# EasyEDA Pro project kuafu01_030内部老化方案_4.eprj, board PCB4 (continued)
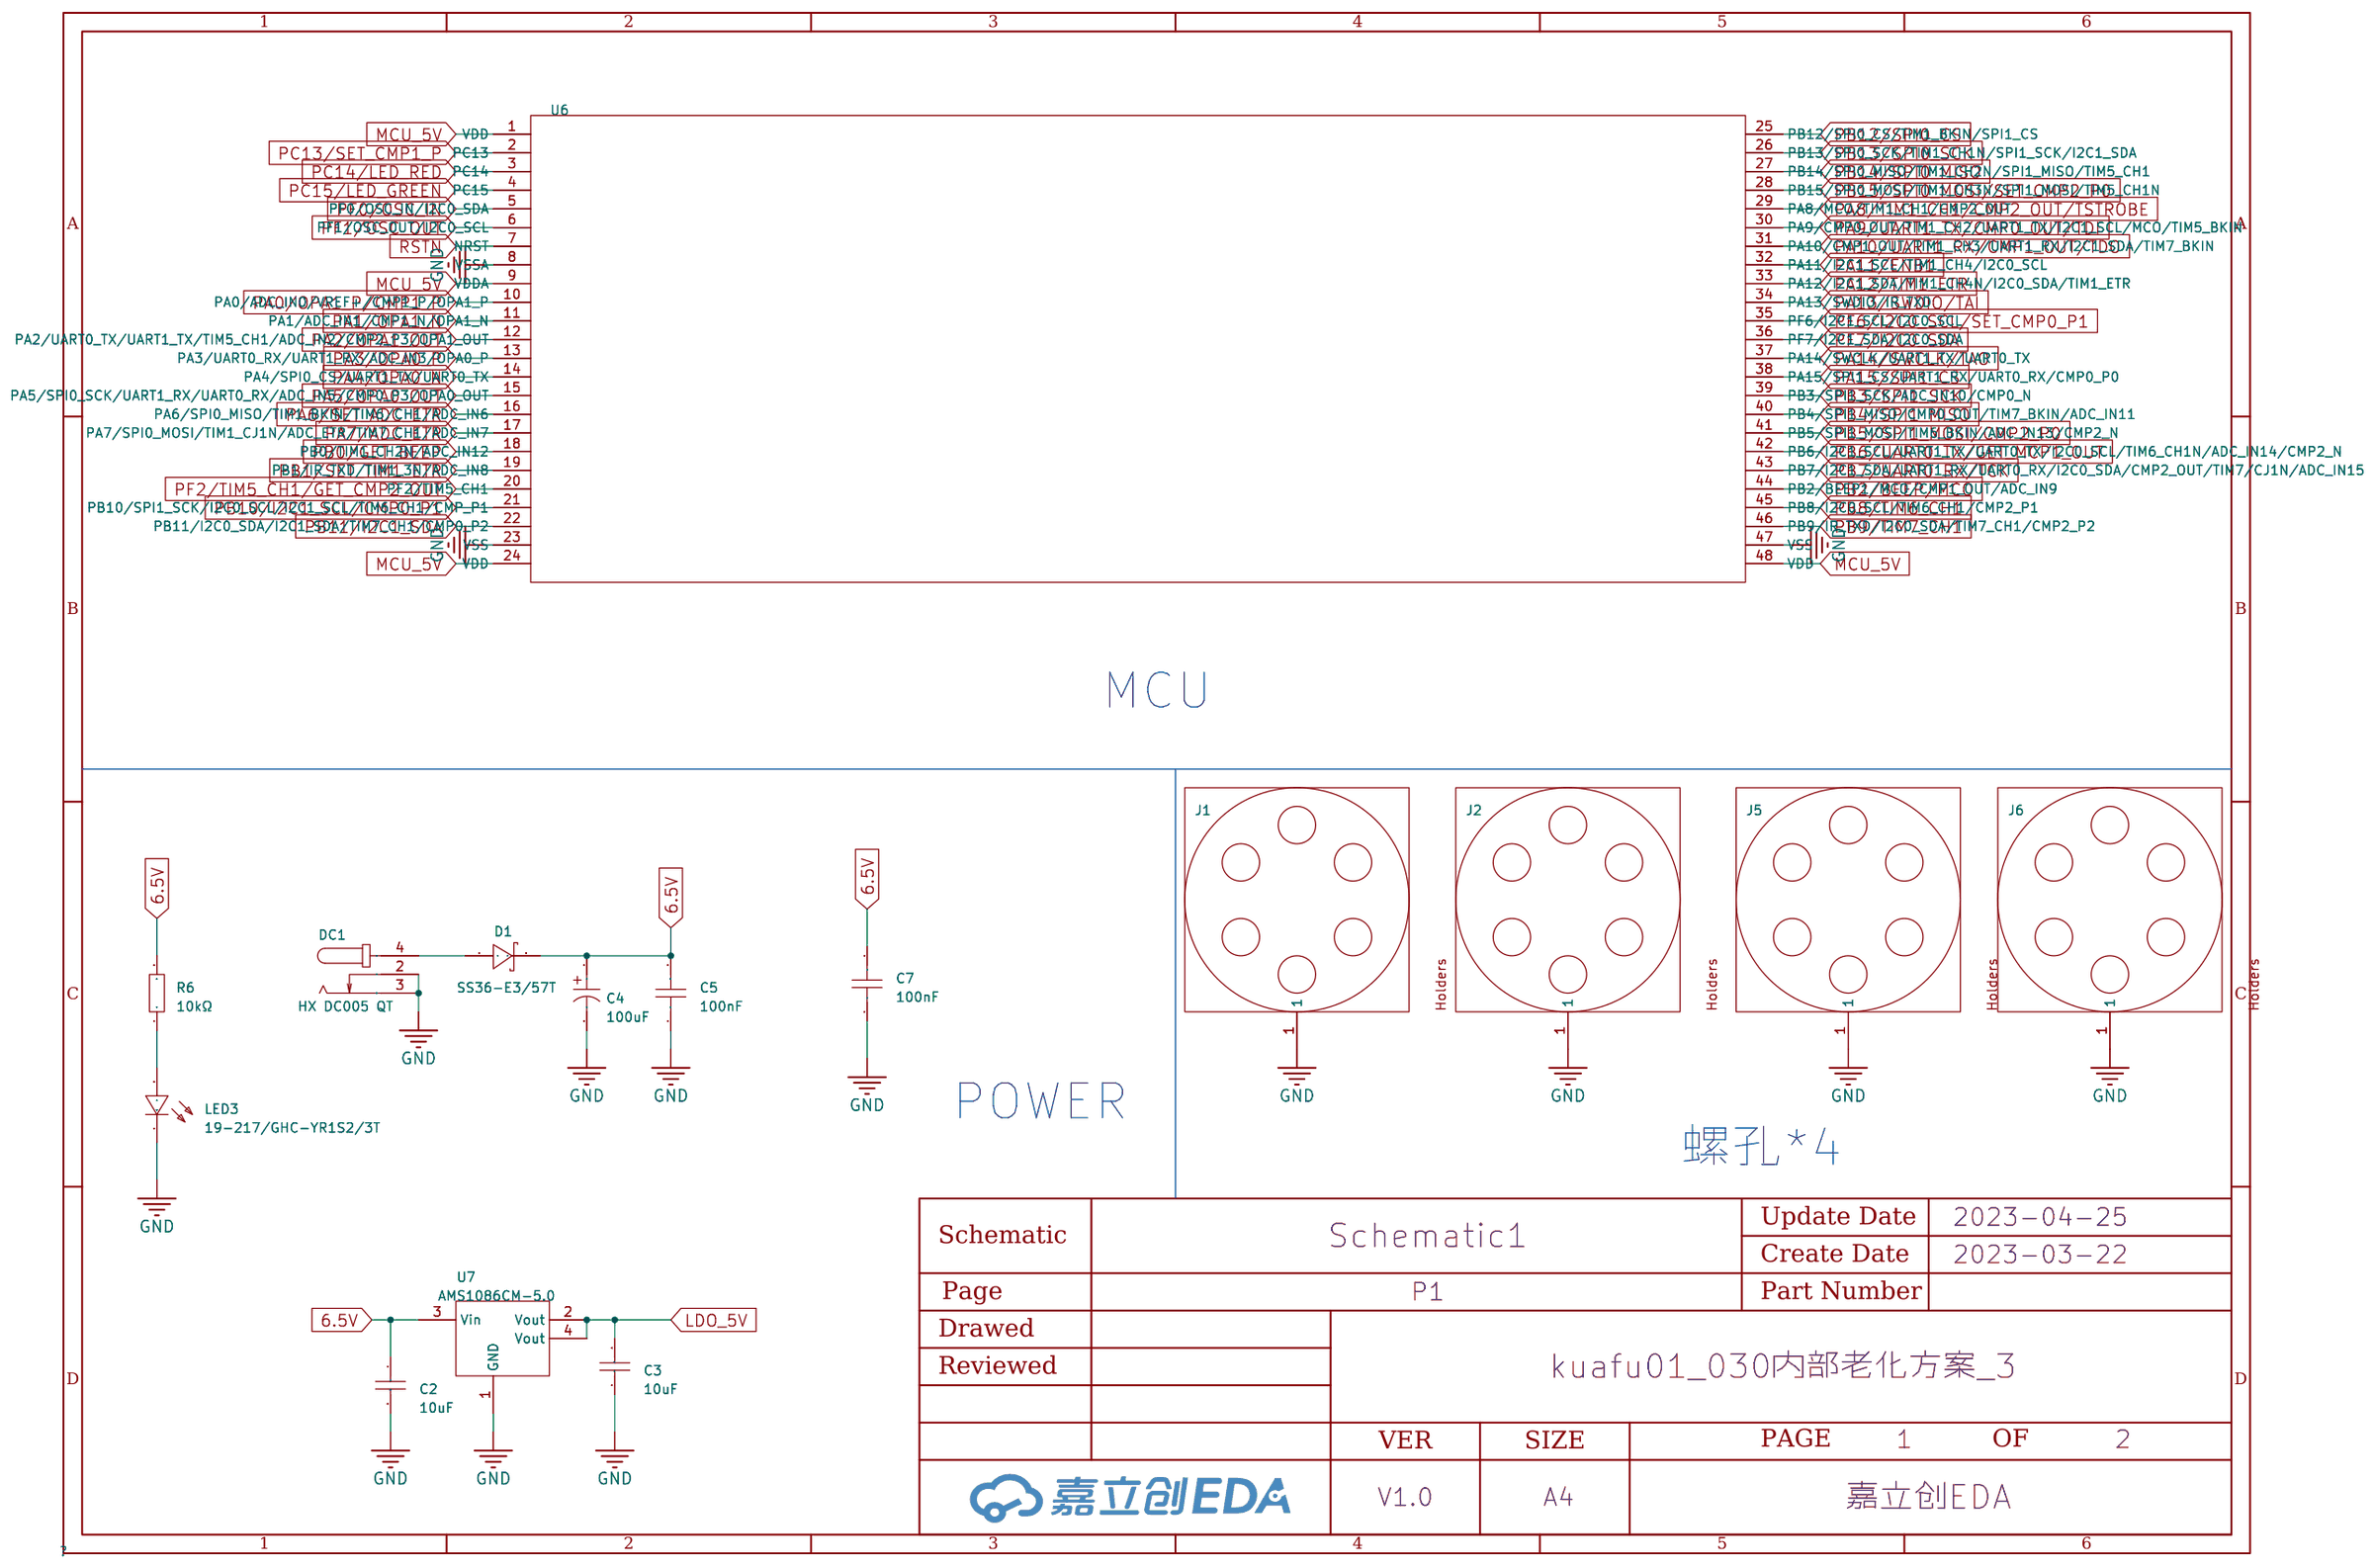
[diagram p0: P1]
## Routing (per net, layer and track width the routed paths; a pad name or vN(x,y) marks a point on that pad's centre or on a via; arc(x,y) is an arc through that point) (continued)
PB14/SPI0_MISO: length 791.7
  Top Layer w0.28: v1(242.26,245.05) 235.5,245.05 234.28,243.83 234.28,242.07 U6#26.40 ; v1(191.71,207.46) 184.95,207.46 183.73,206.24 183.73,204.48 U6#32.40 ; U6#20.27 35.04,85.74 36.06,85.74 36.4,85.4 40.07,85.4 v1(40.07,85.4) ; v1(141.17,169.87) 134.41,169.87 133.19,168.65 133.19,166.89 U6#8.40 ; U6#12.27 136.13,236.1 137.16,236.1 137.49,235.77 141.16,235.77 v1(141.17,235.76) ; U6#21.40 183.73,91.7 183.73,93.47 184.95,94.69 v1(191.71,94.69) ; U6#15.40 234.28,54.11 234.28,55.87 235.5,57.09 v1(242.26,57.09) ; v1(141.17,47.8) 141.16,47.81 137.49,47.81 137.16,48.14 136.13,48.14 U6#13.27 ; v1(141.17,198.17) 141.16,198.17 137.49,198.17 137.16,198.51 136.13,198.51 U6#30.27 ; v1(40.07,132.28) 33.31,132.28 32.09,131.06 32.09,129.29 U6#3.40 ; v1(191.71,85.4) 191.71,85.4 188.04,85.4 187.7,85.74 186.67,85.74 U6#21.27 ; U6#18.27 186.67,48.14 187.7,48.14 188.04,47.81 191.71,47.81 v1(191.71,47.8) ; U6#29.40 82.64,204.48 82.64,206.24 83.86,207.46 v1(90.62,207.46) ; v1(90.62,160.58) 90.62,160.58 86.95,160.58 86.61,160.92 85.58,160.92 U6#11.27 ; v1(242.26,19.5) 235.5,19.5 234.28,18.28 234.28,16.52 U6#24.40 ; v1(90.62,235.76) 90.62,235.77 86.95,235.77 86.61,236.1 85.58,236.1 U6.27 ; v1(191.71,122.99) 191.71,122.99 188.04,122.99 187.7,123.33 186.67,123.33 U6#7.27 ; v1(141.17,160.58) 141.16,160.58 137.49,160.58 137.16,160.92 136.13,160.92 U6#8.27 ; U6#17.40 234.28,91.7 234.28,93.47 235.5,94.69 v1(242.26,94.69) ; v1(191.71,160.58) 191.71,160.58 188.04,160.58 187.7,160.92 186.67,160.92 U6#10.27 ; v1(191.71,132.28) 184.95,132.28 183.73,131.06 183.73,129.29 U6#7.40 ; v1(191.71,169.87) 184.95,169.87 183.73,168.65 183.73,166.89 U6#10.40 ; U6#3.27 35.04,123.33 36.06,123.33 36.4,122.99 40.07,122.99 v1(40.07,122.99) ; U6#28.27 237.22,198.51 238.25,198.51 238.59,198.17 242.26,198.17 v1(242.26,198.17) ; v1(242.26,160.58) 242.26,160.58 238.59,160.58 238.25,160.92 237.22,160.92 U6#6.27 ; v1(40.07,235.76) 40.07,235.77 36.4,235.77 36.06,236.1 35.04,236.1 U6#27.27 ; v1(40.07,19.5) 33.31,19.5 32.09,18.28 32.09,16.52 U6#23.40 ; v1(90.62,132.28) 83.86,132.28 82.64,131.06 82.64,129.29 U6#5.40 ; v1(90.62,122.99) 90.62,122.99 86.95,122.99 86.61,123.33 85.58,123.33 U6#5.27 ; U6#14.40 32.09,54.11 32.09,55.87 33.31,57.09 v1(40.07,57.09) ; U6#31.40 32.09,204.48 32.09,206.24 33.31,207.46 v1(40.07,207.46) ; v1(40.07,198.17) 40.07,198.17 36.4,198.17 36.06,198.51 35.04,198.51 U6#31.27 ; v1(90.62,47.8) 90.62,47.81 86.95,47.81 86.61,48.14 85.58,48.14 U6#16.27 ; v1(90.62,57.09) 83.86,57.09 82.64,55.87 82.64,54.11 U6#16.40 ; U6#27.40 32.09,242.07 32.09,243.83 33.31,245.05 v1(40.07,245.05) ; v1(90.62,198.17) 90.62,198.17 86.95,198.17 86.61,198.51 85.58,198.51 U6#29.27 ; v1(191.71,57.09) 184.95,57.09 183.73,55.87 183.73,54.11 U6#18.40 ; U6#2.27 136.13,123.33 137.16,123.33 137.49,122.99 141.16,122.99 v1(141.17,122.99) ; U6#19.27 136.13,85.74 137.16,85.74 137.49,85.4 141.16,85.4 v1(141.17,85.4) ; v1(90.62,85.4) 90.62,85.4 86.95,85.4 86.61,85.74 85.58,85.74 U6#22.27 ; U6#17.27 237.22,85.74 238.25,85.74 238.59,85.4 242.26,85.4 v1(242.26,85.4) ; U6#28.40 234.28,204.48 234.28,206.24 235.5,207.46 v1(242.26,207.46) ; U6#9.40 32.09,166.89 32.09,168.65 33.31,169.87 v1(40.07,169.87) ; U6.40 82.64,242.07 82.64,243.83 83.86,245.05 v1(90.62,245.05) ; v1(141.17,245.05) 134.41,245.05 133.19,243.83 133.19,242.07 U6#12.40 ; v1(242.26,122.99) 242.26,122.99 238.59,122.99 238.25,123.33 237.22,123.33 U6#4.27 ; v1(90.62,94.69) 83.86,94.69 82.64,93.47 82.64,91.7 U6#22.40 ; U6#30.40 133.19,204.48 133.19,206.24 134.41,207.46 v1(141.17,207.46) ; v1(141.17,57.09) 134.41,57.09 133.19,55.87 133.19,54.11 U6#13.40 ; U6#32.27 186.67,198.51 187.7,198.51 188.04,198.17 191.71,198.17 v1(191.71,198.17) ; v1(40.07,160.58) 40.07,160.58 36.4,160.58 36.06,160.92 35.04,160.92 U6#9.27 ; U6#20.40 32.09,91.7 32.09,93.47 33.31,94.69 v1(40.07,94.69) ; U6#25.40 183.73,242.07 183.73,243.83 184.95,245.05 v1(191.71,245.05) ; v1(90.62,169.87) 83.86,169.87 82.64,168.65 82.64,166.89 U6#11.40 ; U6#24.27 237.22,10.55 238.25,10.55 238.59,10.21 242.26,10.21 v1(242.26,10.21) ; U6#2.40 133.19,129.29 133.19,131.06 134.41,132.28 v1(141.17,132.28) ; v1(242.26,169.87) 235.5,169.87 234.28,168.65 234.28,166.89 U6#6.40 ; U6#19.40 133.19,91.7 133.19,93.47 134.41,94.69 v1(141.17,94.69) ; v1(242.26,132.28) 235.5,132.28 234.28,131.06 234.28,129.29 U6#4.40 ; U6#15.27 237.22,48.14 238.25,48.14 238.59,47.81 242.26,47.81 v1(242.26,47.8) ; v1(40.07,47.8) 40.07,47.81 36.4,47.81 36.06,48.14 35.04,48.14 U6#14.27 ; v1(191.71,235.76) 191.71,235.77 188.04,235.77 187.7,236.1 186.67,236.1 U6#25.27 ; U6#26.27 237.22,236.1 238.25,236.1 238.59,235.77 242.26,235.77 v1(242.26,235.76) ; U6#23.27 35.04,10.55 36.06,10.55 36.4,10.21 40.07,10.21 v1(40.07,10.21)
  Bottom Layer w0.28: v1(242.26,122.99) v1(242.26,132.28) ; v1(242.26,198.17) v1(242.26,207.46) ; v1(242.26,85.4) v1(242.26,94.69) ; v1(90.62,160.58) v1(90.62,169.87) ; v1(242.26,160.58) v1(242.26,169.87) ; v1(90.62,122.99) v1(90.62,132.28) ; v1(40.07,160.58) v1(40.07,169.87) ; v1(40.07,198.17) v1(40.07,207.46) ; v1(242.26,10.21) v1(242.26,19.5) ; v1(40.07,122.99) v1(40.07,132.28) ; v1(40.07,10.21) v1(40.07,19.5) ; v1(141.17,160.58) v1(141.17,169.87) ; v1(242.26,47.8) v1(242.26,57.09) ; v1(191.71,198.17) v1(191.71,207.46) ; v1(141.17,198.17) v1(141.17,207.46) ; v1(90.62,198.17) v1(90.62,207.46) ; v1(141.17,122.99) v1(141.17,132.28) ; v1(141.17,235.76) v1(141.17,245.05) ; v1(191.71,235.76) v1(191.71,245.05) ; v1(40.07,47.8) v1(40.07,57.09) ; v1(90.62,85.4) v1(90.62,94.69) ; v1(141.17,47.8) v1(141.17,57.09) ; v1(141.17,85.4) v1(141.17,94.69) ; v1(90.62,235.76) v1(90.62,245.05) ; v1(191.71,85.4) v1(191.71,94.69) ; v1(90.62,47.8) v1(90.62,57.09) ; v1(191.71,122.99) v1(191.71,132.28) ; v1(40.07,235.76) v1(40.07,245.05) ; v1(242.26,235.76) v1(242.26,245.05) ; v1(191.71,160.58) v1(191.71,169.87) ; v1(40.07,85.4) v1(40.07,94.69) ; v1(191.71,47.8) v1(191.71,57.09)
PB15/SPI0_MOSI/SET_CMP2_P0: length 860.6
  Top Layer w0.28: v1(91.18,161.18) 87.44,161.18 87.19,161.42 U6#11.28 ; 82.13,91.69 82.13,93.9 83.57,95.34 v1(91.18,95.34) ; v1(242.82,48.4) 239.07,48.4 238.83,48.65 U6#15.28 ; 132.68,166.88 132.68,169.08 134.12,170.52 v1(141.73,170.52) ; v1(242.82,86) 239.07,86 238.83,86.24 U6#17.28 ; U6.28 87.19,236.61 87.44,236.36 v1(91.18,236.36) ; 233.77,166.88 233.77,169.08 235.21,170.52 v1(242.82,170.52) ; U6#14.28 36.64,48.65 36.89,48.4 v1(40.63,48.4) ; v1(192.27,123.59) 188.53,123.59 188.28,123.83 U6#7.28 ; U6#23.28 36.64,11.06 36.89,10.81 v1(40.63,10.81) ; v1(192.27,170.52) 184.66,170.52 183.22,169.08 183.22,166.88 ; v1(242.82,132.93) 235.21,132.93 233.77,131.49 233.77,129.28 ; v1(141.73,198.77) 137.98,198.77 137.74,199.02 U6#30.28 ; U6#21.28 188.28,86.24 188.53,86 v1(192.27,86) ; U6#16.28 87.19,48.65 87.44,48.4 v1(91.18,48.4) ; v1(40.63,161.18) 36.89,161.18 36.64,161.42 U6#9.28 ; v1(141.73,48.4) 137.98,48.4 137.74,48.65 U6#13.28 ; 82.13,242.06 82.13,244.26 83.57,245.7 v1(91.18,245.7) ; v1(40.63,95.34) 33.02,95.34 31.58,93.9 31.58,91.69 ; v1(242.82,236.36) 239.07,236.36 238.83,236.61 U6#26.28 ; v1(242.82,198.77) 239.07,198.77 238.83,199.02 U6#28.28 ; v1(192.27,132.93) 184.66,132.93 183.22,131.49 183.22,129.28 ; v1(192.27,236.36) 188.53,236.36 188.28,236.61 U6#25.28 ; U6#2.28 137.74,123.83 137.98,123.59 v1(141.73,123.59) ; v1(141.73,86) 137.98,86 137.74,86.24 U6#19.28 ; 82.13,54.1 82.13,56.3 83.57,57.74 v1(91.18,57.74) ; 31.58,129.28 31.58,131.49 33.02,132.93 v1(40.63,132.93) ; U6#4.28 238.83,123.83 239.07,123.59 v1(242.82,123.59) ; 132.68,129.28 132.68,131.49 134.12,132.93 v1(141.73,132.93) ; v1(91.18,132.93) 83.57,132.93 82.13,131.49 82.13,129.28 ; v1(242.82,20.15) 235.21,20.15 233.77,18.71 233.77,16.51 ; v1(40.63,20.15) 33.02,20.15 31.58,18.71 31.58,16.51 ; v1(242.82,10.81) 239.07,10.81 238.83,11.06 U6#24.28 ; U6#12.28 137.74,236.61 137.98,236.36 v1(141.73,236.36) ; U6#18.28 188.28,48.65 188.53,48.4 v1(192.27,48.4) ; v1(91.18,198.77) 87.44,198.77 87.19,199.02 U6#29.28 ; 31.58,166.88 31.58,169.08 33.02,170.52 v1(40.63,170.52) ; 183.22,242.06 183.22,244.26 184.66,245.7 v1(192.27,245.7) ; v1(242.82,245.7) 235.21,245.7 233.77,244.26 233.77,242.06 ; 82.13,204.47 82.13,206.67 83.57,208.11 v1(91.18,208.11) ; 31.58,242.06 31.58,244.26 33.02,245.7 v1(40.63,245.7) ; 233.77,91.69 233.77,93.9 235.21,95.34 v1(242.82,95.34) ; U6#8.28 137.74,161.42 137.98,161.18 v1(141.73,161.18) ; 183.22,91.69 183.22,93.9 184.66,95.34 v1(192.27,95.34) ; v1(91.18,123.59) 87.44,123.59 87.19,123.83 U6#5.28 ; 233.77,204.47 233.77,206.67 235.21,208.11 v1(242.82,208.11) ; U6#32.28 188.28,199.02 188.53,198.77 v1(192.27,198.77) ; v1(40.63,57.74) 33.02,57.74 31.58,56.3 31.58,54.1 ; U6#20.28 36.64,86.24 36.89,86 v1(40.63,86) ; 132.68,204.47 132.68,206.67 134.12,208.11 v1(141.73,208.11) ; v1(192.27,208.11) 184.66,208.11 183.22,206.67 183.22,204.47 ; v1(192.27,57.74) 184.66,57.74 183.22,56.3 183.22,54.1 ; 132.68,54.1 132.68,56.3 134.12,57.74 v1(141.73,57.74) ; U6#6.28 238.83,161.42 239.07,161.18 v1(242.82,161.18) ; U6#31.28 36.64,199.02 36.89,198.77 v1(40.63,198.77) ; v1(40.63,236.36) 36.89,236.36 36.64,236.61 U6#27.28 ; v1(91.18,170.52) 83.57,170.52 82.13,169.08 82.13,166.88 ; 132.68,91.69 132.68,93.9 134.12,95.34 v1(141.73,95.34) ; v1(141.73,245.7) 134.12,245.7 132.68,244.26 132.68,242.06 ; U6#22.28 87.19,86.24 87.44,86 v1(91.18,86) ; U6#10.28 188.28,161.42 188.53,161.18 v1(192.27,161.18) ; v1(40.63,208.11) 33.02,208.11 31.58,206.67 31.58,204.47 ; U6#3.28 36.64,123.83 36.89,123.59 v1(40.63,123.59) ; v1(242.82,57.74) 235.21,57.74 233.77,56.3 233.77,54.1
  Bottom Layer w0.28: v1(91.18,95.34) v1(91.18,86) ; v1(91.18,170.52) v1(91.18,161.18) ; v1(192.27,208.11) v1(192.27,198.77) ; v1(141.73,132.93) v1(141.73,123.59) ; v1(40.63,208.11) v1(40.63,198.77) ; v1(242.82,20.15) v1(242.82,10.81) ; v1(141.73,57.74) v1(141.73,48.4) ; v1(242.82,132.93) v1(242.82,123.59) ; v1(192.27,57.74) v1(192.27,48.4) ; v1(91.18,208.11) v1(91.18,198.77) ; v1(141.73,245.7) v1(141.73,236.36) ; v1(40.63,170.52) v1(40.63,161.18) ; v1(91.18,57.74) v1(91.18,48.4) ; v1(192.27,170.52) v1(192.27,161.18) ; v1(91.18,132.93) v1(91.18,123.59) ; v1(141.73,170.52) v1(141.73,161.18) ; v1(242.82,57.74) v1(242.82,48.4) ; v1(40.63,57.74) v1(40.63,48.4) ; v1(192.27,245.7) v1(192.27,236.36) ; v1(192.27,95.34) v1(192.27,86) ; v1(192.27,132.93) v1(192.27,123.59) ; v1(40.63,132.93) v1(40.63,123.59) ; v1(141.73,95.34) v1(141.73,86) ; v1(40.63,20.15) v1(40.63,10.81) ; v1(242.82,170.52) v1(242.82,161.18) ; v1(141.73,208.11) v1(141.73,198.77) ; v1(40.63,95.34) v1(40.63,86) ; v1(91.18,245.7) v1(91.18,236.36) ; v1(40.63,245.7) v1(40.63,236.36) ; v1(242.82,245.7) v1(242.82,236.36) ; v1(242.82,95.34) v1(242.82,86) ; v1(242.82,208.11) v1(242.82,198.77)
PC13/SET_CMP1_P: length 338.5
  Top Layer w0.28: H7#12.2 220.46,54.09 224.63,54.09 226.57,52.15 228.82,52.15 ; U6#16.2 74.93,52.15 72.99,54.09 68.82,54.09 H7#19.2 ; H7#4.2 119.36,129.27 123.54,129.27 125.48,127.33 127.73,127.33 ; H7#22.2 169.91,91.68 174.08,91.68 176.02,89.74 U6#21.2 ; 26.63,89.74 24.38,89.74 22.45,91.68 18.27,91.68 H7#20.2 ; 228.82,240.11 226.57,240.11 224.63,242.05 220.46,242.05 H7#27.2 ; U6#25.2 176.02,240.11 174.08,242.05 169.91,242.05 H7#26.2 ; H7#11.2 169.91,166.86 174.08,166.86 176.02,164.92 U6#10.2 ; U6#7.2 176.02,127.33 174.08,129.27 169.91,129.27 H7#6.2 ; 127.73,164.92 125.48,164.92 123.54,166.86 119.36,166.86 H7#5.2 ; 228.82,14.56 226.57,14.56 224.63,16.49 220.46,16.49 H7#24.2 ; H7#8.2 68.82,129.27 72.99,129.27 74.93,127.33 U6#5.2 ; 26.63,14.56 24.38,14.56 22.45,16.49 18.27,16.49 H7#23.2 ; H7#31.2 18.27,204.45 22.45,204.45 24.38,202.52 26.63,202.52 ; U6.2 74.93,240.11 72.99,242.05 68.82,242.05 H7.2 ; 26.63,52.15 24.38,52.15 22.45,54.09 18.27,54.09 H7#13.2 ; H7#15.2 119.36,54.09 123.54,54.09 125.48,52.15 127.73,52.15 ; 228.82,89.74 226.57,89.74 224.63,91.68 220.46,91.68 H7#18.2 ; H7#21.2 68.82,91.68 72.99,91.68 74.93,89.74 U6#22.2 ; H7#28.2 119.36,204.45 123.54,204.45 125.48,202.52 127.73,202.52 ; U6#32.2 176.02,202.52 174.08,204.45 169.91,204.45 H7#32.2 ; 26.63,164.92 24.38,164.92 22.45,166.86 18.27,166.86 H7#9.2 ; H7#29.2 68.82,204.45 72.99,204.45 74.93,202.52 U6#29.2 ; H7#30.2 220.46,204.45 224.63,204.45 226.57,202.52 228.82,202.52 ; H7#3.2 18.27,129.27 22.45,129.27 24.38,127.33 26.63,127.33 ; U6#11.2 74.93,164.92 72.99,166.86 68.82,166.86 H7#10.2 ; H7#17.2 169.91,54.09 174.08,54.09 176.02,52.15 U6#18.2 ; 127.73,89.74 125.48,89.74 123.54,91.68 119.36,91.68 H7#16.2 ; H7#14.2 119.36,242.05 123.54,242.05 125.48,240.11 127.73,240.11 ; H7#25.2 18.27,242.05 22.45,242.05 24.38,240.11 26.63,240.11 ; 228.82,164.92 226.57,164.92 224.63,166.86 220.46,166.86 H7#7.2 ; 228.82,127.33 226.57,127.33 224.63,129.27 220.46,129.27 H7#2.2
PC14/LED_RED: length 373.8
  Top Layer w0.28: H1#17.2 219.46,88.61 222,91.16 224.4,91.16 226.31,89.24 228.82,89.24 ; U6#11.3 74.67,164.42 72.76,166.34 70.37,166.34 67.82,163.79 H1#9.2 ; H1#19.2 17.27,88.61 19.82,91.16 22.21,91.16 24.13,89.24 26.63,89.24 ; 228.82,202.02 226.31,202.02 224.4,203.93 222,203.93 219.46,201.38 H1#30.2 ; 127.73,239.61 125.22,239.61 123.3,241.52 120.91,241.52 118.36,238.98 H1#15.2 ; H1.2 67.82,238.98 70.37,241.52 72.76,241.52 74.67,239.61 U6.3 ; 26.63,202.02 24.13,202.02 22.21,203.93 19.82,203.93 17.27,201.38 H1#31.2 ; H1#18.2 118.36,88.61 120.91,91.16 123.3,91.16 125.22,89.24 127.73,89.24 ; H1#26.2 168.91,238.98 171.46,241.52 173.85,241.52 175.76,239.61 U6#25.3 ; 127.73,126.83 125.22,126.83 123.3,128.75 120.91,128.75 118.36,126.2 H1#5.2 ; 228.82,51.65 226.31,51.65 224.4,53.56 222,53.56 219.46,51.02 H1#12.2 ; 127.73,51.65 125.22,51.65 123.3,53.56 120.91,53.56 118.36,51.02 H1#16.2 ; 228.82,164.42 226.31,164.42 224.4,166.34 222,166.34 219.46,163.79 H1#6.2 ; U6#7.3 175.76,126.83 173.85,128.75 171.46,128.75 168.91,126.2 H1#10.2 ; H1#24.2 17.27,238.98 19.82,241.52 22.21,241.52 24.13,239.61 26.63,239.61 ; H1#13.2 67.82,51.02 70.37,53.56 72.76,53.56 74.67,51.65 U6#16.3 ; U6#32.3 175.76,202.02 173.85,203.93 171.46,203.93 168.91,201.38 H1#32.2 ; H1#4.2 17.27,126.2 19.82,128.75 22.21,128.75 24.13,126.83 26.63,126.83 ; U6#5.3 74.67,126.83 72.76,128.75 70.37,128.75 67.82,126.2 H1#3.2 ; H1#7.2 118.36,163.79 120.91,166.34 123.3,166.34 125.22,164.42 127.73,164.42 ; 26.63,164.42 24.13,164.42 22.21,166.34 19.82,166.34 17.27,163.79 H1#8.2 ; U6#21.3 175.76,89.24 173.85,91.16 171.46,91.16 168.91,88.61 H1#22.2 ; 228.82,14.06 226.31,14.06 224.4,15.97 222,15.97 219.46,13.42 H1#25.2 ; H1#2.2 219.46,126.2 222,128.75 224.4,128.75 226.31,126.83 228.82,126.83 ; H1#29.2 118.36,201.38 120.91,203.93 123.3,203.93 125.22,202.02 127.73,202.02 ; 26.63,51.65 24.13,51.65 22.21,53.56 19.82,53.56 17.27,51.02 H1#14.2 ; H1#27.2 219.46,238.98 222,241.52 224.4,241.52 226.31,239.61 228.82,239.61 ; H1#23.2 17.27,13.42 19.82,15.97 22.21,15.97 24.13,14.06 26.63,14.06 ; U6#22.3 74.67,89.24 72.76,91.16 70.37,91.16 67.82,88.61 H1#20.2 ; H1#28.2 67.82,201.38 70.37,203.93 72.76,203.93 74.67,202.02 U6#29.3 ; H1#11.2 168.91,163.79 171.46,166.34 173.85,166.34 175.76,164.42 U6#10.3 ; H1#21.2 168.91,51.02 171.46,53.56 173.85,53.56 175.76,51.65 U6#18.3
PC15/LED_GREEN: length 422.9
  Top Layer w0.28: v3(124.21,201.68) 124.81,201.68 124.97,201.52 127.73,201.52 ; v3(23.11,88.9) 23.72,88.9 23.88,88.74 26.63,88.74 ; v3(124.21,88.9) 124.81,88.9 124.97,88.74 127.73,88.74 ; v3(225.3,13.72) 225.9,13.72 226.06,13.56 228.82,13.56 ; v3(174.75,51.31) 175.35,51.31 175.51,51.15 U6#18.4 ; 26.63,126.33 23.88,126.33 23.72,126.49 v3(23.11,126.49) ; v3(225.3,88.9) 225.9,88.9 226.06,88.74 228.82,88.74 ; 127.73,239.11 124.97,239.11 124.81,239.27 v3(124.21,239.27) ; v3(73.66,126.49) 74.26,126.49 74.42,126.33 U6#5.4 ; 127.73,163.92 124.97,163.92 124.81,164.08 v3(124.21,164.08) ; 228.82,201.52 226.06,201.52 225.9,201.68 v3(225.3,201.68) ; 26.63,51.15 23.88,51.15 23.72,51.31 v3(23.11,51.31) ; U6#32.4 175.51,201.52 175.35,201.68 v3(174.75,201.68) ; U6#16.4 74.42,51.15 74.26,51.31 v3(73.66,51.31) ; v3(124.21,51.31) 124.81,51.31 124.97,51.15 127.73,51.15 ; v3(23.11,13.72) 23.72,13.72 23.88,13.56 26.63,13.56 ; v3(73.66,239.27) 74.26,239.27 74.42,239.11 U6.4 ; 228.82,163.92 226.06,163.92 225.9,164.08 v3(225.3,164.08) ; v3(23.11,164.08) 23.72,164.08 23.88,163.92 26.63,163.92 ; v3(73.66,88.9) 74.26,88.9 74.42,88.74 U6#22.4 ; U6#7.4 175.51,126.33 175.35,126.49 v3(174.75,126.49) ; 127.73,126.33 124.97,126.33 124.81,126.49 v3(124.21,126.49) ; U6#21.4 175.51,88.74 175.35,88.9 v3(174.75,88.9) ; v3(73.66,164.08) 74.26,164.08 74.42,163.92 U6#11.4 ; 228.82,239.11 226.06,239.11 225.9,239.27 v3(225.3,239.27) ; v3(225.3,51.31) 225.9,51.31 226.06,51.15 228.82,51.15 ; 26.63,201.52 23.88,201.52 23.72,201.68 v3(23.11,201.68) ; U6#10.4 175.51,163.92 175.35,164.08 v3(174.75,164.08) ; v3(73.66,201.68) 74.26,201.68 74.42,201.52 U6#29.4 ; v3(225.3,126.49) 225.9,126.49 226.06,126.33 228.82,126.33 ; 26.63,239.11 23.88,239.11 23.72,239.27 v3(23.11,239.27) ; v3(174.75,239.27) 175.35,239.27 175.51,239.11 U6#25.4
  Bottom Layer w0.28: v3(73.66,164.08) 73.67,164.07 73.67,161.15 72.33,159.81 68.52,159.81 67.82,160.5 ; 219.46,47.73 220.16,47.03 223.97,47.03 225.31,48.37 225.31,51.3 v3(225.3,51.31) ; v3(23.11,51.31) 23.12,51.3 23.12,48.37 21.78,47.03 17.97,47.03 17.28,47.73 ; v3(124.21,201.68) 124.22,201.67 124.22,198.74 122.87,197.4 119.06,197.4 118.37,198.1 ; 168.91,47.73 169.61,47.03 173.42,47.03 174.76,48.37 174.76,51.3 v3(174.75,51.31) ; v3(225.3,201.68) 225.31,201.67 225.31,198.74 223.97,197.4 220.16,197.4 219.46,198.1 ; 67.82,235.69 68.52,234.99 72.33,234.99 73.67,236.33 73.67,239.26 v3(73.66,239.27) ; 219.46,10.14 220.16,9.44 223.97,9.44 225.31,10.78 225.31,13.71 v3(225.3,13.72) ; 67.82,85.32 68.52,84.62 72.33,84.62 73.67,85.97 73.67,88.89 v3(73.66,88.9) ; 168.91,160.5 169.61,159.81 173.42,159.81 174.76,161.15 174.76,164.07 v3(174.75,164.08) ; v3(73.66,126.49) 73.67,126.48 73.67,123.56 72.33,122.22 68.52,122.22 67.82,122.91 ; 219.46,122.91 220.16,122.22 223.97,122.22 225.31,123.56 225.31,126.48 v3(225.3,126.49) ; 17.28,85.32 17.97,84.62 21.78,84.62 23.12,85.97 23.12,88.89 v3(23.11,88.9) ; 17.28,235.69 17.97,234.99 21.78,234.99 23.12,236.33 23.12,239.26 v3(23.11,239.27) ; 17.28,160.5 17.97,159.81 21.78,159.81 23.12,161.15 23.12,164.07 v3(23.11,164.08) ; 219.46,160.5 220.16,159.81 223.97,159.81 225.31,161.15 225.31,164.07 v3(225.3,164.08) ; v3(23.11,13.72) 23.12,13.71 23.12,10.78 21.78,9.44 17.97,9.44 17.28,10.14 ; v3(174.75,239.27) 174.76,239.26 174.76,236.33 173.42,234.99 169.61,234.99 168.91,235.69 ; 219.46,85.32 220.16,84.62 223.97,84.62 225.31,85.97 225.31,88.89 v3(225.3,88.9) ; v3(124.21,88.9) 124.22,88.89 124.22,85.97 122.87,84.62 119.06,84.62 118.37,85.32 ; 219.46,235.69 220.16,234.99 223.97,234.99 225.31,236.33 225.31,239.26 v3(225.3,239.27) ; v3(73.66,51.31) 73.67,51.3 73.67,48.37 72.33,47.03 68.52,47.03 67.82,47.73 ; v3(124.21,126.49) 124.22,126.48 124.22,123.56 122.87,122.22 119.06,122.22 118.37,122.91 ; 17.28,198.1 17.97,197.4 21.78,197.4 23.12,198.74 23.12,201.67 v3(23.11,201.68) ; 118.37,235.69 119.06,234.99 122.87,234.99 124.22,236.33 124.22,239.26 v3(124.21,239.27) ; 168.91,122.91 169.61,122.22 173.42,122.22 174.76,123.56 174.76,126.48 v3(174.75,126.49) ; 118.37,160.5 119.06,159.81 122.87,159.81 124.22,161.15 124.22,164.07 v3(124.21,164.08) ; v3(174.75,88.9) 174.76,88.89 174.76,85.97 173.42,84.62 169.61,84.62 168.91,85.32 ; v3(73.66,201.68) 73.67,201.67 73.67,198.74 72.33,197.4 68.52,197.4 67.82,198.1 ; v3(23.11,126.49) 23.12,126.48 23.12,123.56 21.78,122.22 17.97,122.22 17.28,122.91 ; v3(174.75,201.68) 174.76,201.67 174.76,198.74 173.42,197.4 169.61,197.4 168.91,198.1 ; 118.37,47.73 119.06,47.03 122.87,47.03 124.22,48.37 124.22,51.3 v3(124.21,51.31)
PERIPHERAL_5V: length 3142.1
  Top Layer w0.5: H9#4.1 14.71,168.42 7.32,168.42 6.14,167.24 LED1#5.2 6.14,163.05 LED2#4.2 6.14,163 6.14,153.2 7.68,151.66 9.32,151.66 ; 110.42,76.48 110.44,76.5 C1#23.1 110.58,80.41 U1#14.1 ; 110.42,76.48 108.78,76.48 107.24,78.02 107.24,87.81 LED2#22.2 107.23,87.86 LED1#22.2 107.23,92.05 108.42,93.24 115.81,93.24 H9#21.1 ; 110.42,76.48 129.11,76.48 ; v2(50.56,77.03) 50.01,76.48 28.02,76.48 ; v2(204.13,51.92) R4#17.1 204.12,55.62 R5#19.2 ; R5#4.2 254.67,130.8 R4#10.1 v2(254.68,127.11) ; 28.02,226.84 28.03,226.86 28.03,228.91 27.33,229.61 U2#23.5 ; 28.02,226.84 9.32,226.84 ; 28.02,226.84 50.01,226.84 v2(50.56,227.39) ; v2(254.68,89.52) R4#18.1 254.67,93.21 R5#16.2 ; v2(151.66,77.03) 151.11,76.48 129.11,76.48 ; 211.51,76.48 211.53,76.5 C1#17.1 211.67,80.41 U1#19.1 ; 211.51,76.48 209.87,76.48 208.33,78.02 208.33,87.81 LED2#18.2 208.33,87.86 LED1#12.2 208.33,92.05 209.51,93.24 216.9,93.24 H9#18.1 ; 211.51,76.48 230.2,76.48 ; H9#16.1 65.26,55.64 57.87,55.64 56.69,54.46 LED1#19.2 56.69,50.27 LED2#17.2 56.69,50.22 56.69,40.42 58.23,38.88 59.87,38.88 ; v2(103.02,120.86) 103.02,118.12 R3#7.2 103.04,116.92 v2(103.02,116.9) ; H9#19.1 65.26,93.24 57.87,93.24 56.69,92.05 LED1#14.2 56.69,87.86 LED2#19.2 56.69,87.81 56.69,78.02 58.23,76.48 59.87,76.48 ; H9#9.1 216.9,168.42 209.51,168.42 208.33,167.24 LED1.2 208.33,163.05 LED2#7.2 208.33,163 208.33,153.2 209.87,151.66 211.51,151.66 ; 211.51,189.25 230.2,189.25 ; 211.51,189.25 211.53,189.27 C1#30.1 211.67,193.18 U1#31.1 ; 211.51,189.25 209.87,189.25 208.33,190.79 208.33,200.59 LED2#29.2 208.33,200.64 LED1#29.2 208.33,204.83 209.51,206.01 216.9,206.01 H9#30.1 ; 230.2,189.25 252.2,189.25 v2(252.75,189.8) ; 230.2,189.25 230.22,189.27 230.22,191.32 229.52,192.02 U2#28.5 ; 78.56,226.84 78.58,226.86 78.58,228.91 77.88,229.61 U2#8.5 ; 78.56,226.84 59.87,226.84 ; 78.56,226.84 100.56,226.84 v2(101.11,227.39) ; R5#15.2 254.67,55.62 R4#12.1 v2(254.68,51.92) ; 160.96,151.66 159.32,151.66 157.78,153.2 157.78,163 LED2#10.2 157.78,163.05 LED1#8.2 157.78,167.24 158.96,168.42 166.35,168.42 H9#13.1 ; 160.96,151.66 179.66,151.66 ; 160.96,151.66 160.98,151.68 C1#10.1 161.12,155.59 U1#11.1 ; U2#2.5 27.33,116.84 28.03,116.14 28.03,114.08 28.02,114.07 ; R5#5.2 254.67,168.39 R4#6.1 v2(254.68,164.7) ; 28.02,38.88 50.01,38.88 v2(50.56,39.43) ; 28.02,38.88 9.32,38.88 ; 28.02,38.88 28.03,38.9 28.03,40.95 27.33,41.65 U2#13.5 ; 78.56,151.66 100.56,151.66 v2(101.11,152.21) ; 78.56,151.66 78.58,151.68 78.58,153.73 77.88,154.43 U2#4.5 ; 78.56,151.66 59.87,151.66 ; U2#18.5 229.52,41.65 230.22,40.95 230.22,38.9 230.2,38.88 ; 211.51,38.88 211.53,38.9 C1#20.1 211.67,42.81 U1#18.1 ; 211.51,38.88 230.2,38.88 ; 211.51,38.88 209.87,38.88 208.33,40.42 208.33,50.22 LED2#16.2 208.33,50.27 LED1#17.2 208.33,54.46 209.51,55.64 216.9,55.64 H9#17.1 ; 110.42,38.88 129.11,38.88 ; 110.42,38.88 110.44,38.9 C1#14.1 110.58,42.81 U1#16.1 ; 110.42,38.88 108.78,38.88 107.24,40.42 107.24,50.22 LED2#12.2 107.23,50.27 LED1#13.2 107.23,54.46 108.42,55.64 115.81,55.64 H9#15.1 ; 129.11,38.88 129.13,38.9 129.13,40.95 128.43,41.65 U2#12.5 ; 129.11,38.88 151.11,38.88 v2(151.66,39.43) ; v2(254.68,202.29) R4#28.1 254.67,205.98 R5#28.2 ; U2#6.5 27.33,154.43 28.03,153.73 28.03,151.68 28.02,151.66 ; v2(254.68,239.88) R4#27.1 254.67,243.58 R5#27.2 ; v2(151.66,114.62) 151.11,114.07 129.11,114.07 ; v2(252.75,114.62) 252.2,114.07 230.2,114.07 ; v2(204.11,154.49) 204.13,154.51 R3#13.2 204.11,155.71 v2(204.11,158.45) ; v2(254.66,4.12) 254.68,4.14 R3#24.2 254.66,5.34 v2(254.66,8.08) ; v2(103.04,51.92) R4#14.1 103.03,55.62 R5#18.2 ; v2(103.02,196.04) 103.02,193.3 R3#31.2 103.04,192.1 v2(103.02,192.08) ; U1#8.1 211.67,155.59 C1#6.1 211.53,151.68 211.51,151.66 ; 9.32,151.66 28.02,151.66 ; 9.32,151.66 9.34,151.68 C1#4.1 9.48,155.59 U1#6.1 ; v2(153.59,127.11) R4#3.1 153.58,130.8 R5#2.2 ; U2#30.5 27.33,192.02 28.03,191.32 28.03,189.27 28.02,189.25 ; 28.02,151.66 50.01,151.66 v2(50.56,152.21) ; v2(153.59,202.29) R4#30.1 153.58,205.98 R5#30.2 ; v2(202.2,227.39) 201.65,226.84 179.66,226.84 ; v2(52.47,79.31) 52.49,79.33 R3.2 52.47,80.53 v2(52.47,83.27) ; 9.32,38.88 9.34,38.9 C1#16.1 9.48,42.81 U1#15.1 ; 9.32,38.88 7.68,38.88 6.14,40.42 6.14,50.22 LED2#13.2 6.14,50.27 LED1#15.2 6.14,54.46 7.32,55.64 14.71,55.64 H9#2.1 ; v2(52.47,192.08) 52.49,192.1 R3#29.2 52.47,193.3 v2(52.47,196.04) ; 59.87,226.84 58.23,226.84 56.69,228.38 56.69,238.18 LED2#3.2 56.69,238.23 LED1#27.2 56.69,242.42 57.87,243.6 65.26,243.6 H9#3.1 ; 59.87,226.84 59.89,226.86 C1#2.1 60.03,230.77 U1.1 ; 59.87,38.88 59.89,38.9 C1#18.1 60.03,42.81 U1#20.1 ; 59.87,38.88 78.56,38.88 ; 160.96,76.48 179.66,76.48 ; 160.96,76.48 160.98,76.5 C1#21.1 161.12,80.41 U1#23.1 ; 160.96,76.48 159.32,76.48 157.78,78.02 157.78,87.81 LED2#21.2 157.78,87.86 LED1#18.2 157.78,92.05 158.96,93.24 166.35,93.24 H9#22.1 ; 179.66,76.48 179.67,76.49 179.67,78.55 178.97,79.25 U2#20.5 ; 179.66,76.48 201.65,76.48 v2(202.2,77.03) ; v2(101.11,189.8) 100.56,189.25 78.56,189.25 ; R5#24.2 52.48,18.02 R4#24.1 v2(52.49,14.33) ; H9#27.1 216.9,243.6 209.51,243.6 208.33,242.42 LED1#26.2 208.33,238.23 LED2#27.2 208.33,238.18 208.33,228.38 209.87,226.84 211.51,226.84 ; 78.56,114.07 100.56,114.07 v2(101.11,114.62) ; 78.56,114.07 78.58,114.08 78.58,116.14 77.88,116.84 U2#3.5 ; 78.56,114.07 59.87,114.07 ; 179.66,151.66 179.67,151.68 179.67,153.73 178.97,154.43 U2#10.5 ; 179.66,151.66 201.65,151.66 v2(202.2,152.21) ; 230.2,38.88 252.2,38.88 v2(252.75,39.43) ; 78.56,189.25 78.58,189.27 78.58,191.32 77.88,192.02 U2#29.5 ; 78.56,189.25 59.87,189.25 ; U2#27.5 229.52,229.61 230.22,228.91 230.22,226.86 230.2,226.84 ; 110.42,189.25 108.78,189.25 107.24,190.79 107.24,200.59 LED2#30.2 107.23,200.64 LED1#31.2 107.23,204.83 108.42,206.01 115.81,206.01 H9#31.1 ; 110.42,189.25 129.11,189.25 ; 110.42,189.25 110.44,189.27 C1#28.1 110.58,193.18 U1#28.1 ; R5#12.2 153.58,243.58 R4#13.1 v2(153.59,239.88) ; 78.56,38.88 78.58,38.9 78.58,40.95 77.88,41.65 U2#14.5 ; 78.56,38.88 100.56,38.88 v2(101.11,39.43) ; v2(204.11,229.67) 204.13,229.69 R3#26.2 204.11,230.9 v2(204.11,233.63) ; v2(202.2,114.62) 201.65,114.07 179.66,114.07 ; H9#7.1 65.26,130.83 57.87,130.83 56.69,129.65 LED1#9.2 56.69,125.45 LED2#6.2 56.69,125.41 56.69,115.61 58.23,114.07 59.87,114.07 ; U2.5 128.43,116.84 129.13,116.14 129.13,114.08 129.11,114.07 ; v2(153.57,79.31) 153.59,79.33 R3#21.2 153.57,80.53 v2(153.57,83.27) ; U1#22.1 9.48,230.77 C1#22.1 9.34,226.86 9.32,226.84 ; R5.2 103.03,243.58 R4.1 v2(103.04,239.88) ; 230.2,226.84 252.2,226.84 v2(252.75,227.39) ; 230.2,226.84 211.51,226.84 ; H9#6.1 115.81,130.83 108.42,130.83 107.23,129.65 LED1#2.2 107.23,125.45 LED2.2 107.24,125.41 107.24,115.61 108.78,114.07 110.42,114.07 ; 160.96,226.84 179.66,226.84 ; 160.96,226.84 159.32,226.84 157.78,228.38 157.78,238.18 LED2#26.2 157.78,238.23 LED1#21.2 157.78,242.42 158.96,243.6 166.35,243.6 H9#26.1 ; 160.96,226.84 160.98,226.86 C1#26.1 161.12,230.77 U1#26.1 ; 179.66,226.84 179.67,226.86 179.67,228.91 178.97,229.61 U2#26.5 ; 230.2,76.48 252.2,76.48 v2(252.75,77.03) ; 230.2,76.48 230.22,76.49 230.22,78.55 229.52,79.25 U2#16.5 ; v2(254.66,154.49) 254.68,154.51 R3#10.2 254.66,155.71 v2(254.66,158.45) ; v2(52.49,89.52) R4#19.1 52.48,93.21 R5#14.2 ; v2(52.47,4.12) 52.49,4.14 R3#23.2 52.47,5.34 v2(52.47,8.08) ; 160.96,189.25 159.32,189.25 157.78,190.79 157.78,200.59 LED2#32.2 157.78,200.64 LED1#32.2 157.78,204.83 158.96,206.01 166.35,206.01 H9#32.1 ; 160.96,189.25 179.66,189.25 ; 160.96,189.25 160.98,189.27 C1#29.1 161.12,193.18 U1#30.1 ; H9#8.1 216.9,130.83 209.51,130.83 208.33,129.65 LED1#7.2 208.33,125.45 LED2#5.2 208.33,125.41 208.33,115.61 209.87,114.07 211.51,114.07 ; v2(52.47,154.49) 52.49,154.51 R3#4.2 52.47,155.71 v2(52.47,158.45) ; U2#19.5 178.97,41.65 179.67,40.95 179.67,38.9 179.66,38.88 ; R5#17.2 52.48,55.62 R4#16.1 v2(52.49,51.92) ; v2(254.66,233.63) 254.66,230.9 R3#27.2 254.68,229.69 v2(254.66,229.67) ; 9.32,226.84 7.68,226.84 6.14,228.38 6.14,238.18 LED2#23.2 6.14,238.23 LED1#23.2 6.14,242.42 7.32,243.6 14.71,243.6 H9#25.1 ; 59.87,151.66 59.89,151.68 C1#8.1 60.03,155.59 U1#10.1 ; 59.87,151.66 58.23,151.66 56.69,153.2 56.69,163 LED2#8.2 56.69,163.05 LED1#3.2 56.69,167.24 57.87,168.42 65.26,168.42 H9#10.1 ; v2(204.11,192.08) 204.13,192.1 R3#30.2 204.11,193.3 v2(204.11,196.04) ; v2(254.66,196.04) 254.66,193.3 R3#28.2 254.68,192.1 v2(254.66,192.08) ; R5#21.2 103.03,93.21 R4#21.1 v2(103.04,89.52) ; 129.11,189.25 151.11,189.25 v2(151.66,189.8) ; 129.11,189.25 129.13,189.27 129.13,191.32 128.43,192.02 U2#31.5 ; R5#10.2 103.03,168.39 R4#9.1 v2(103.04,164.7) ; U2#17.5 27.33,79.25 28.03,78.55 28.03,76.49 28.02,76.48 ; 179.66,189.25 201.65,189.25 v2(202.2,189.8) ; 179.66,189.25 179.67,189.27 179.67,191.32 178.97,192.02 U2#32.5 ; v2(204.11,41.71) 204.13,41.73 R3#16.2 204.11,42.94 v2(204.11,45.67) ; v2(52.47,233.63) 52.47,230.9 R3#25.2 52.49,229.69 v2(52.47,229.67) ; U2#15.5 77.88,79.25 78.58,78.55 78.58,76.49 78.56,76.48 ; U1#32.1 60.03,193.18 C1#32.1 59.89,189.27 59.87,189.25 ; v2(151.66,227.39) 151.11,226.84 129.11,226.84 ; v2(254.68,14.33) R4#25.1 254.67,18.02 R5#25.2 ; 211.51,114.07 211.53,114.09 C1#9.1 211.67,118 U1#7.1 ; 211.51,114.07 230.2,114.07 ; 160.96,38.88 160.98,38.9 C1#12.1 161.12,42.81 U1#13.1 ; 160.96,38.88 159.32,38.88 157.78,40.42 157.78,50.22 LED2#20.2 157.78,50.27 LED1#20.2 157.78,54.46 158.96,55.64 166.35,55.64 H9#20.1 ; 160.96,38.88 179.66,38.88 ; v2(254.66,83.27) 254.66,80.53 R3#20.2 254.68,79.33 v2(254.66,79.31) ; 9.32,1.29 9.34,1.31 C1#24.1 9.48,5.22 U1#24.1 ; 9.32,1.29 28.02,1.29 ; 9.32,1.29 7.68,1.29 6.14,2.83 6.14,12.63 LED2#24.2 6.14,12.68 LED1#24.2 6.14,16.87 7.32,18.05 14.71,18.05 H9#23.1 ; 110.42,226.84 108.78,226.84 107.24,228.38 107.24,238.18 LED2#14.2 107.23,238.23 LED1#6.2 107.23,242.42 108.42,243.6 115.81,243.6 H9#14.1 ; 110.42,226.84 110.44,226.86 C1#13.1 110.58,230.77 U1#12.1 ; 110.42,226.84 129.11,226.84 ; 129.11,226.84 129.13,226.86 129.13,228.91 128.43,229.61 U2#21.5 ; R5#29.2 52.48,205.98 R4#29.1 v2(52.49,202.29) ; H9#29.1 14.71,206.01 7.32,206.01 6.14,204.83 LED1#30.2 6.14,200.64 LED2#28.2 6.14,200.59 6.14,190.79 7.68,189.25 9.32,189.25 ; 211.51,226.84 211.53,226.86 C1#27.1 211.67,230.77 U1#27.1 ; U1#3.1 110.58,155.59 C1#11.1 110.44,151.68 110.42,151.66 ; 230.2,1.29 252.2,1.29 v2(252.75,1.84) ; 230.2,1.29 211.51,1.29 ; 230.2,1.29 230.22,1.31 230.22,3.36 229.52,4.06 U2#25.5 ; v2(103.02,233.63) 103.02,230.9 R3#2.2 103.04,229.69 v2(103.02,229.67) ; 110.42,151.66 129.11,151.66 ; 110.42,151.66 108.78,151.66 107.24,153.2 107.24,163 LED2#11.2 107.23,163.05 LED1#11.2 107.23,167.24 108.42,168.42 115.81,168.42 H9#12.1 ; 129.11,151.66 129.13,151.68 129.13,153.73 128.43,154.43 U2#11.5 ; 129.11,151.66 151.11,151.66 v2(151.66,152.21) ; v2(103.04,202.29) R4#31.1 103.03,205.98 R5#31.2 ; 59.87,189.25 58.23,189.25 56.69,190.79 56.69,200.59 LED2#31.2 56.69,200.64 LED1#28.2 56.69,204.83 57.87,206.01 65.26,206.01 H9#28.1 ; H9#5.1 14.71,130.83 7.32,130.83 6.14,129.65 LED1#4.2 6.14,125.45 LED2#2.2 6.14,125.41 6.14,115.61 7.68,114.07 9.32,114.07 ; R5#26.2 204.12,243.58 R4#26.1 v2(204.13,239.88) ; 129.11,114.07 110.42,114.07 ; v2(153.57,120.86) 153.57,118.12 R3#5.2 153.59,116.92 v2(153.57,116.9) ; U2#5.5 229.52,154.43 230.22,153.73 230.22,151.68 230.2,151.66 ; 179.66,114.07 179.67,114.08 179.67,116.14 178.97,116.84 U2#9.5 ; 179.66,114.07 160.96,114.07 ; 211.51,1.29 209.87,1.29 208.33,2.83 208.33,12.63 LED2#25.2 208.33,12.68 LED1#25.2 208.33,16.87 209.51,18.05 216.9,18.05 H9#24.1 ; 211.51,1.29 211.53,1.31 C1#25.1 211.67,5.22 U1#25.1 ; v2(153.57,233.63) 153.57,230.9 R3#12.2 153.59,229.69 v2(153.57,229.67) ; U2#7.5 229.52,116.84 230.22,116.14 230.22,114.08 230.2,114.07 ; R5#7.2 103.03,130.8 R4#2.1 v2(103.04,127.11) ; 129.11,76.48 129.13,76.49 129.13,78.55 128.43,79.25 U2#22.5 ; U1#5.1 110.58,118 C1#3.1 110.44,114.09 110.42,114.07 ; R5#3.2 52.48,168.39 R4#7.1 v2(52.49,164.7) ; v2(153.59,51.92) R4#15.1 153.58,55.62 R5#13.2 ; 28.02,114.07 50.01,114.07 v2(50.56,114.62) ; 28.02,114.07 9.32,114.07 ; 9.32,76.48 9.34,76.5 C1#15.1 9.48,80.41 U1#17.1 ; 9.32,76.48 7.68,76.48 6.14,78.02 6.14,87.81 LED2#15.2 6.14,87.86 LED1#16.2 6.14,92.05 7.32,93.24 14.71,93.24 H9.1 ; 9.32,76.48 28.02,76.48 ; 211.51,151.66 230.2,151.66 ; U1#29.1 9.48,193.18 C1#31.1 9.34,189.27 9.32,189.25 ; R5#9.2 153.58,168.39 R4#8.1 v2(153.59,164.7) ; v2(202.2,39.43) 201.65,38.88 179.66,38.88 ; R5#22.2 204.12,93.21 R4#22.1 v2(204.13,89.52) ; R5#8.2 204.12,130.8 R4#5.1 v2(204.13,127.11) ; v2(103.02,45.67) 103.02,42.94 R3#17.2 103.04,41.73 v2(103.02,41.71) ; R5#23.2 52.48,243.58 R4#23.1 v2(52.49,239.88) ; R5#6.2 52.48,130.8 R4#4.1 v2(52.49,127.11) ; v2(50.56,1.84) 50.01,1.29 28.02,1.29 ; 78.56,76.48 100.56,76.48 v2(101.11,77.03) ; 78.56,76.48 59.87,76.48 ; v2(103.02,158.45) 103.02,155.71 R3#8.2 103.04,154.51 v2(103.02,154.49) ; 59.87,114.07 59.89,114.09 C1#7.1 60.03,118 U1#9.1 ; v2(153.57,158.45) 153.57,155.71 R3#11.2 153.59,154.51 v2(153.57,154.49) ; v2(254.66,45.67) 254.66,42.94 R3#19.2 254.68,41.73 v2(254.66,41.71) ; U1#4.1 9.48,118 C1#5.1 9.34,114.09 9.32,114.07 ; 28.02,1.29 28.03,1.31 28.03,3.36 27.33,4.06 U2#24.5 ; v2(204.11,79.31) 204.13,79.33 R3#22.2 204.11,80.53 v2(204.11,83.27) ; 59.87,76.48 59.89,76.5 C1#19.1 60.03,80.41 U1#21.1 ; 160.96,114.07 160.98,114.09 C1.1 161.12,118 U1#2.1 ; 160.96,114.07 159.32,114.07 157.78,115.61 157.78,125.41 LED2#9.2 157.78,125.45 LED1#10.2 157.78,129.65 158.96,130.83 166.35,130.83 H9#11.1 ; v2(52.47,45.67) 52.47,42.94 R3#14.2 52.49,41.73 v2(52.47,41.71) ; R5#20.2 153.58,93.21 R4#20.1 v2(153.59,89.52) ; v2(103.02,83.27) 103.02,80.53 R3#18.2 103.04,79.33 v2(103.02,79.31) ; R5#32.2 204.12,205.98 R4#32.1 v2(204.13,202.29) ; 28.02,189.25 9.32,189.25 ; 28.02,189.25 50.01,189.25 v2(50.56,189.8) ; v2(252.75,152.21) 252.2,151.66 230.2,151.66 ; v2(52.47,120.86) 52.47,118.12 R3#3.2 52.49,116.92 v2(52.47,116.9) ; v2(153.57,41.71) 153.59,41.73 R3#15.2 153.57,42.94 v2(153.57,45.67) ; v2(204.11,120.86) 204.11,118.12 R3#6.2 204.13,116.92 v2(204.11,116.9) ; v2(153.57,192.08) 153.59,192.1 R3#32.2 153.57,193.3 v2(153.57,196.04) ; v2(204.13,164.7) R4#11.1 204.12,168.39 R5#11.2 ; v2(254.66,116.9) 254.68,116.92 R3#9.2 254.66,118.12 v2(254.66,120.86)